# Altium schematic sheet 0221_GPU GDDR6 CHANNELS.SchDoc
size 848 x 558 mm
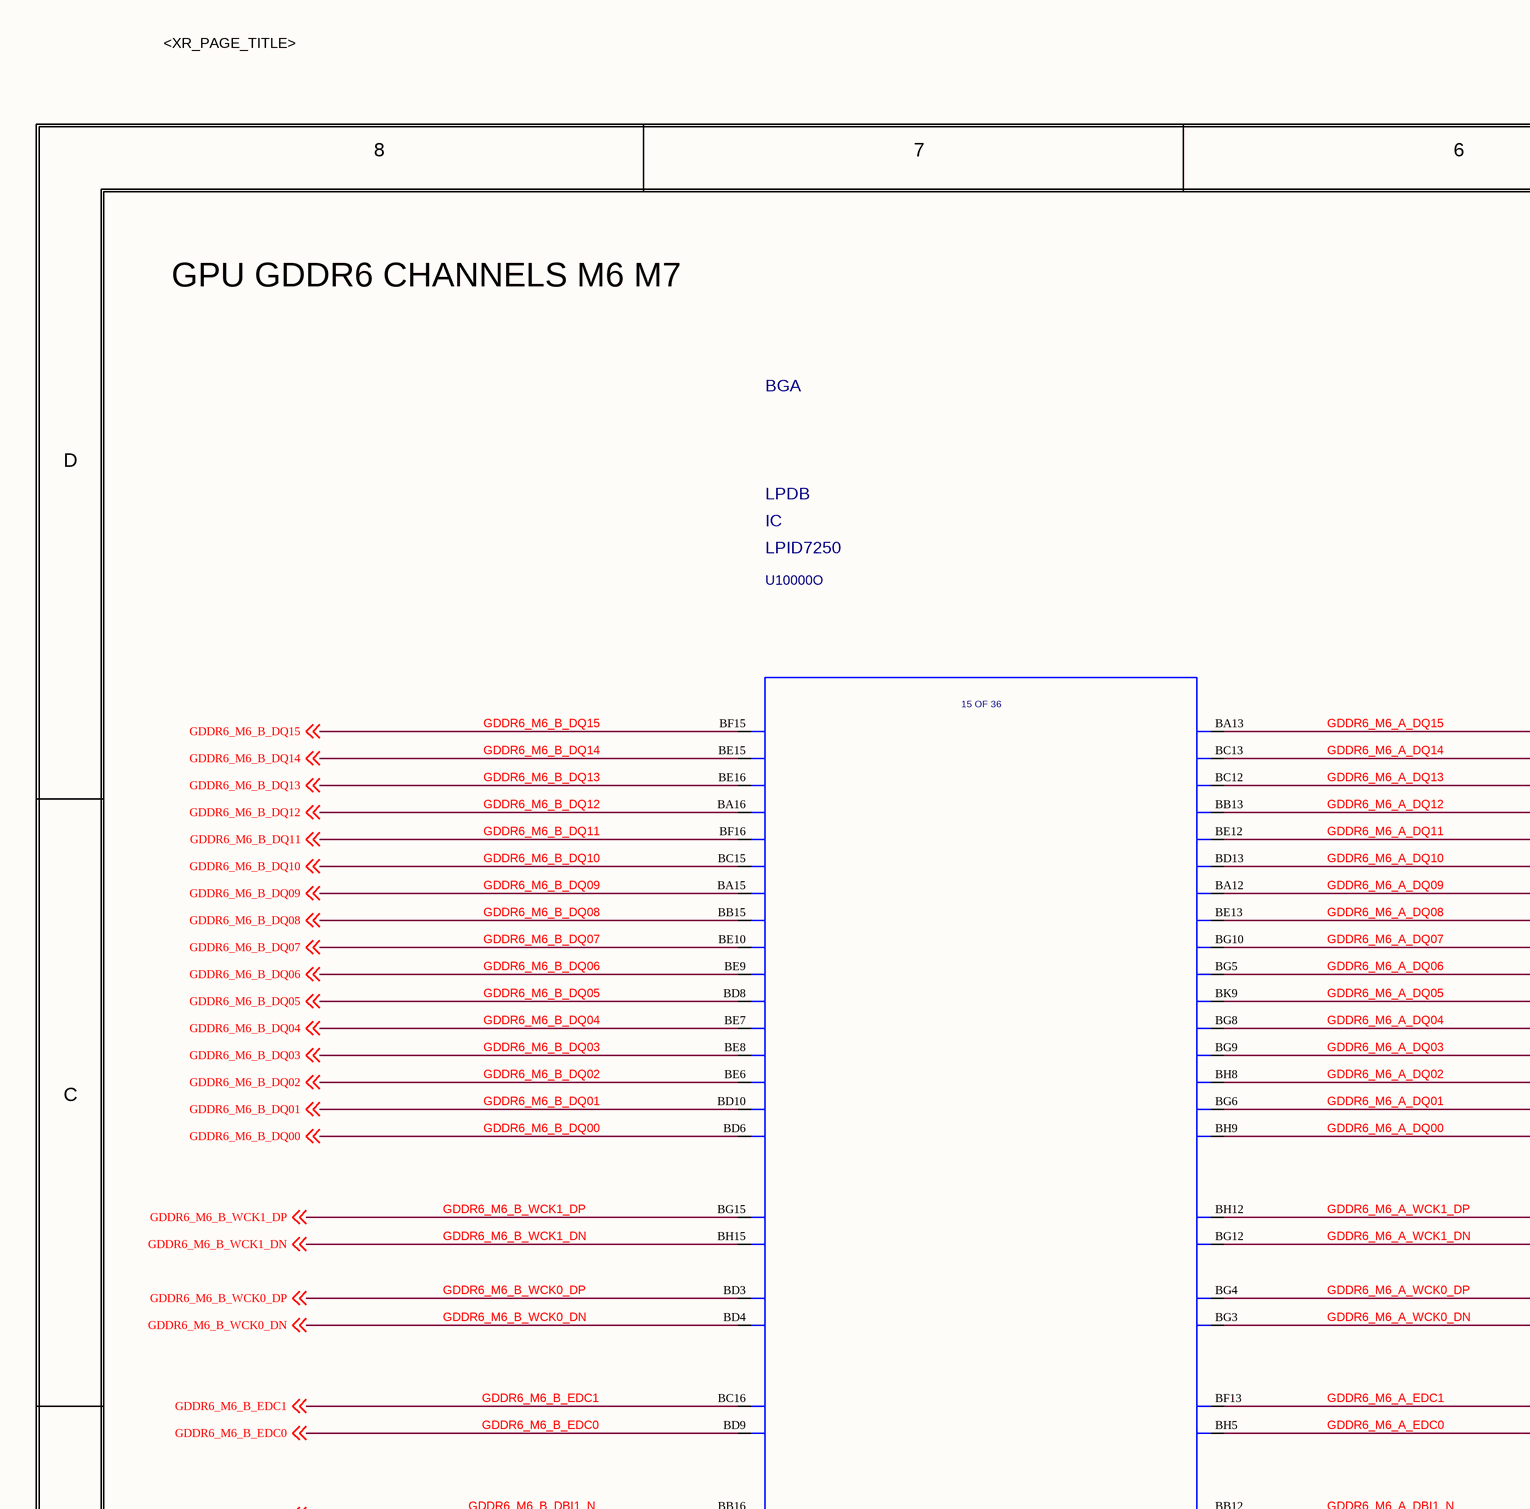
[diagram p0: 0221_GPU GDDR6 CHANNELS.SchDoc, top left]
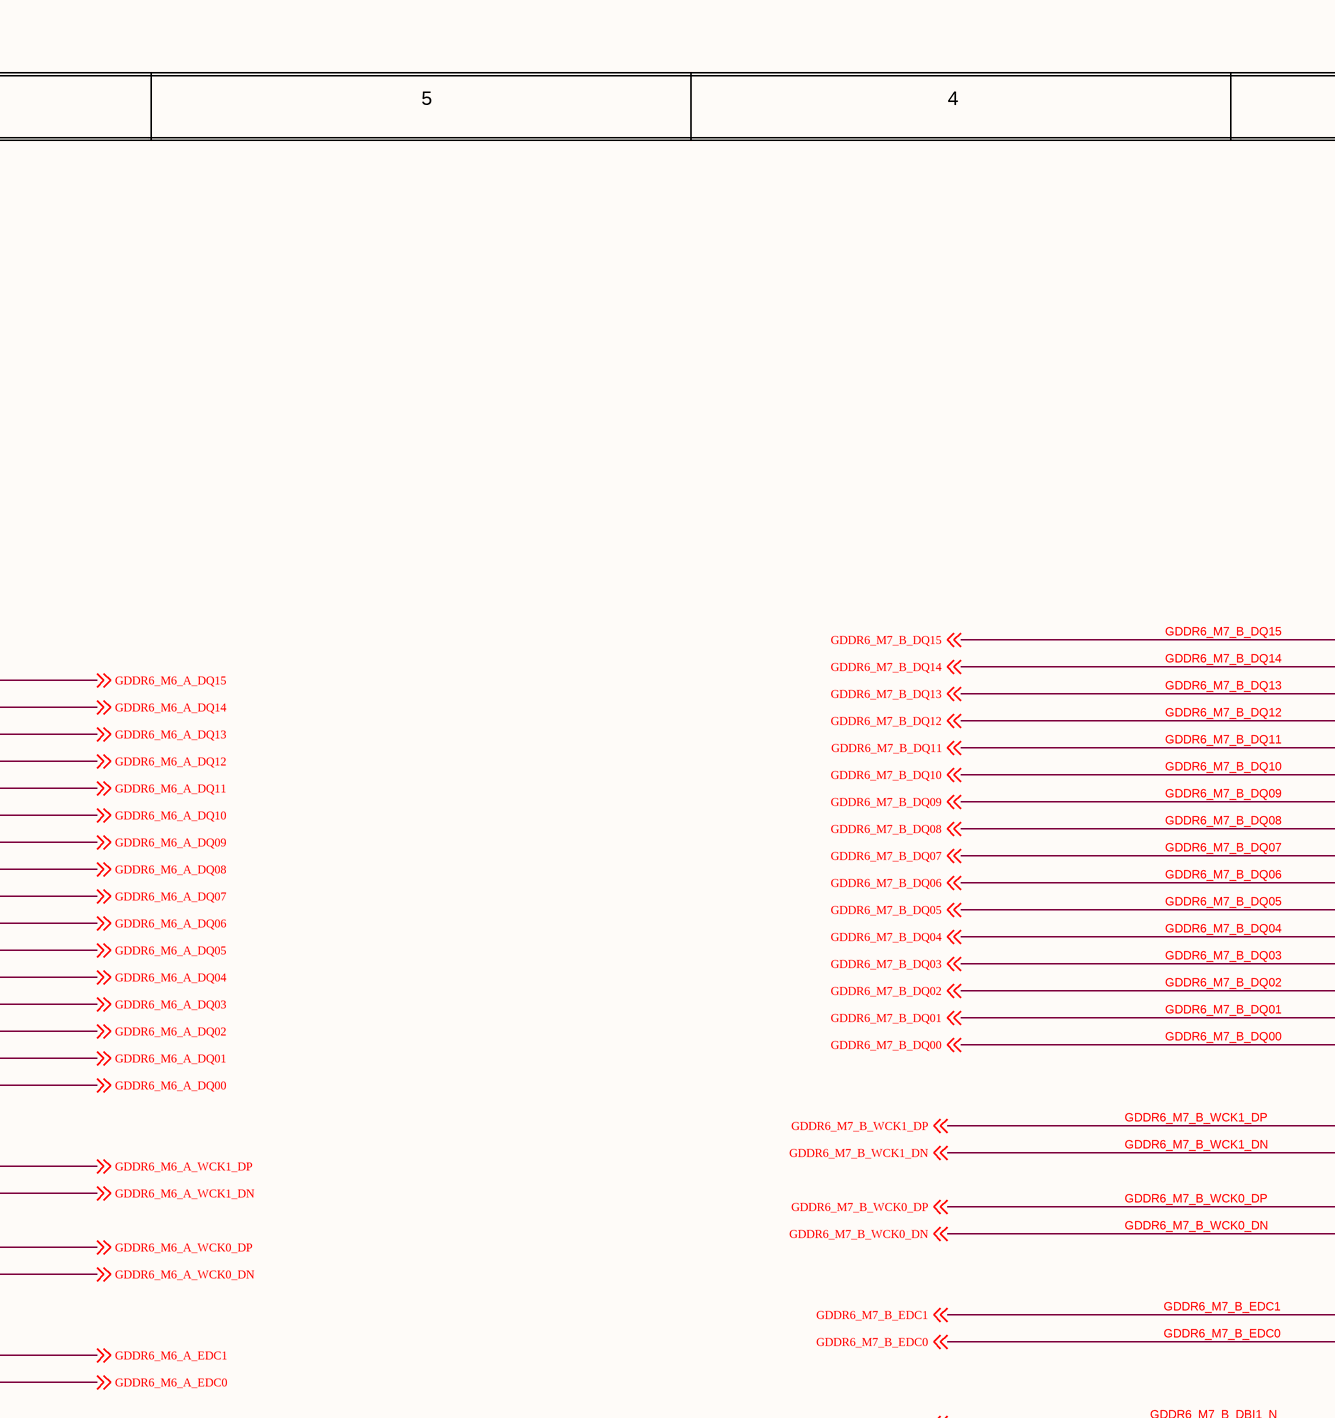
[diagram p1: 0221_GPU GDDR6 CHANNELS.SchDoc, top middle]
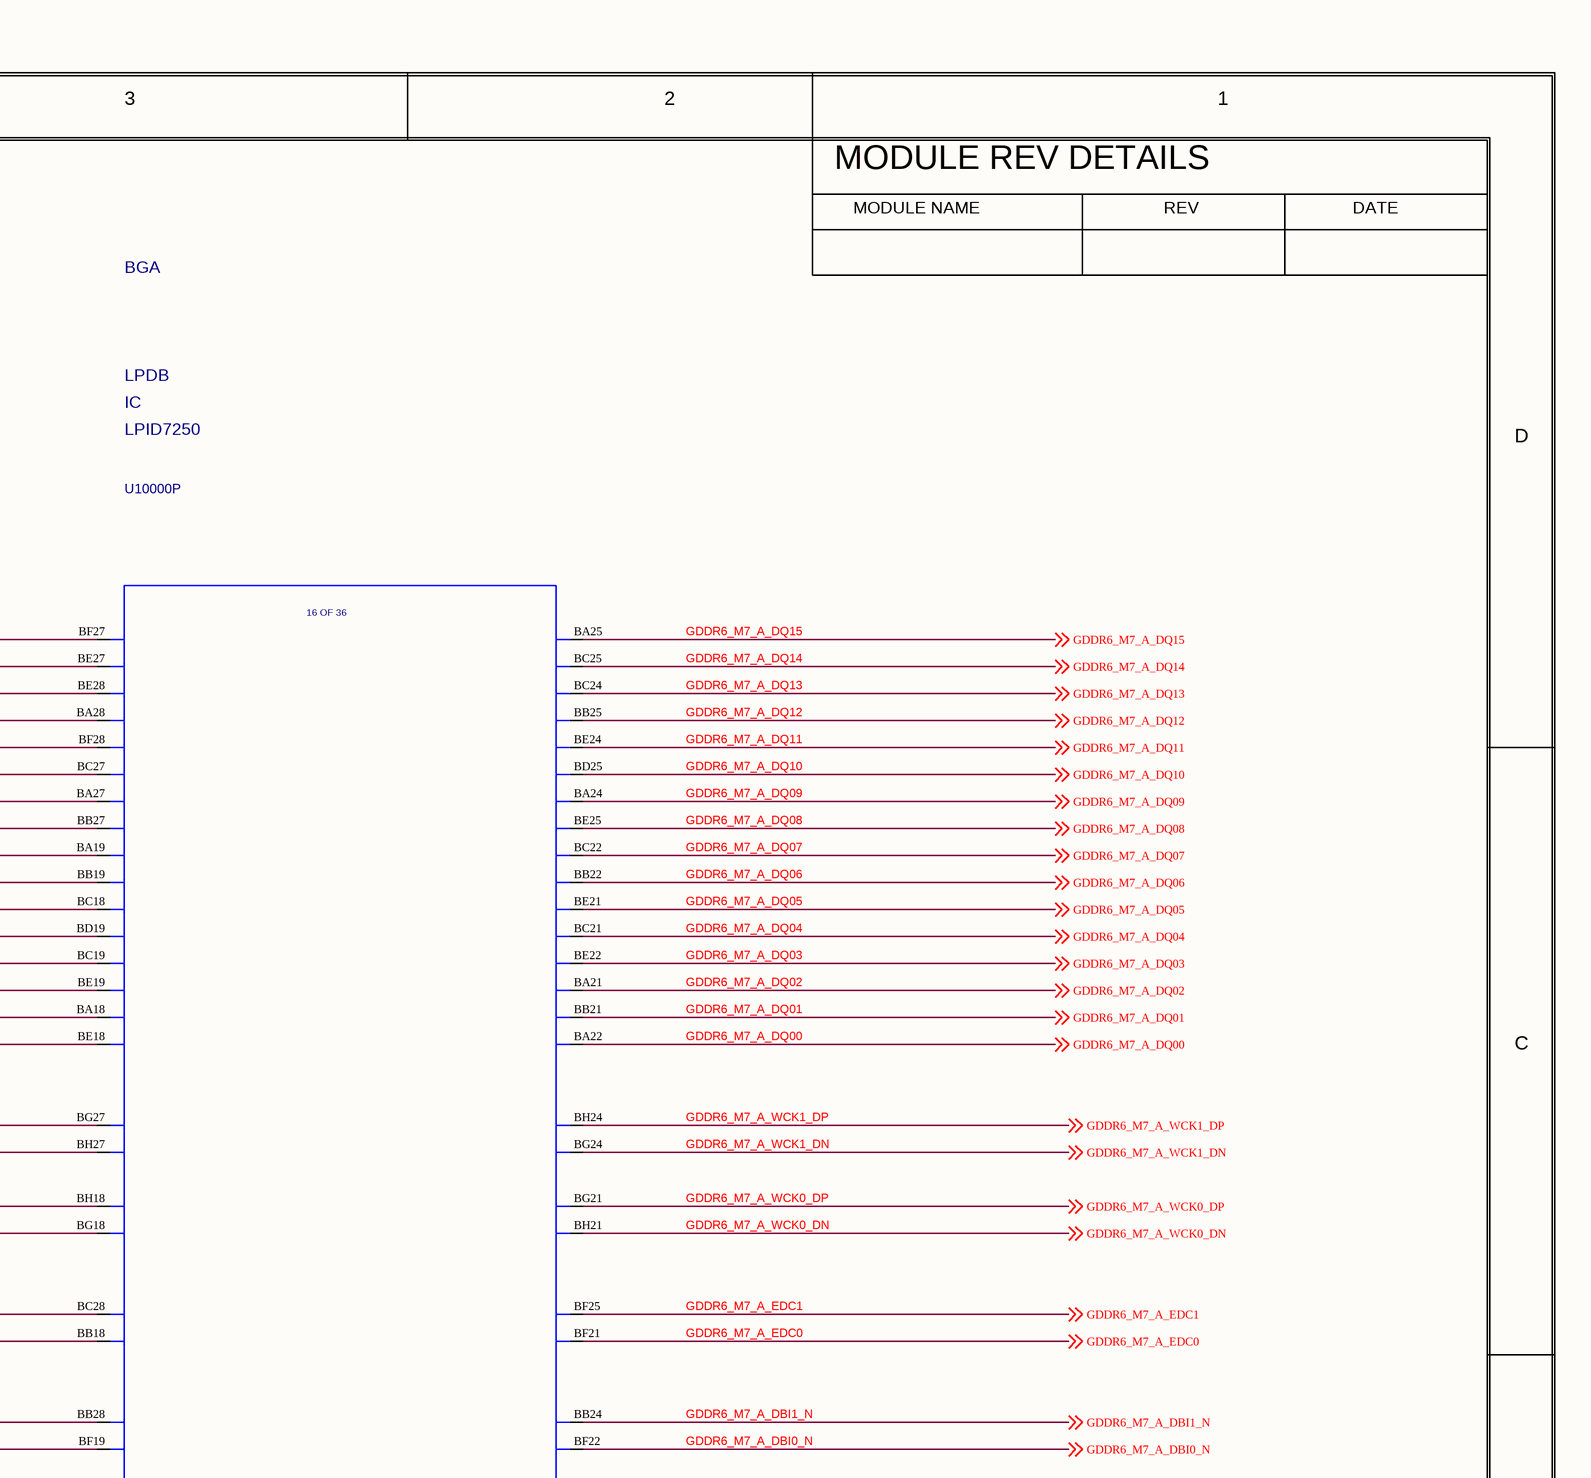
[diagram p2: 0221_GPU GDDR6 CHANNELS.SchDoc, top right]
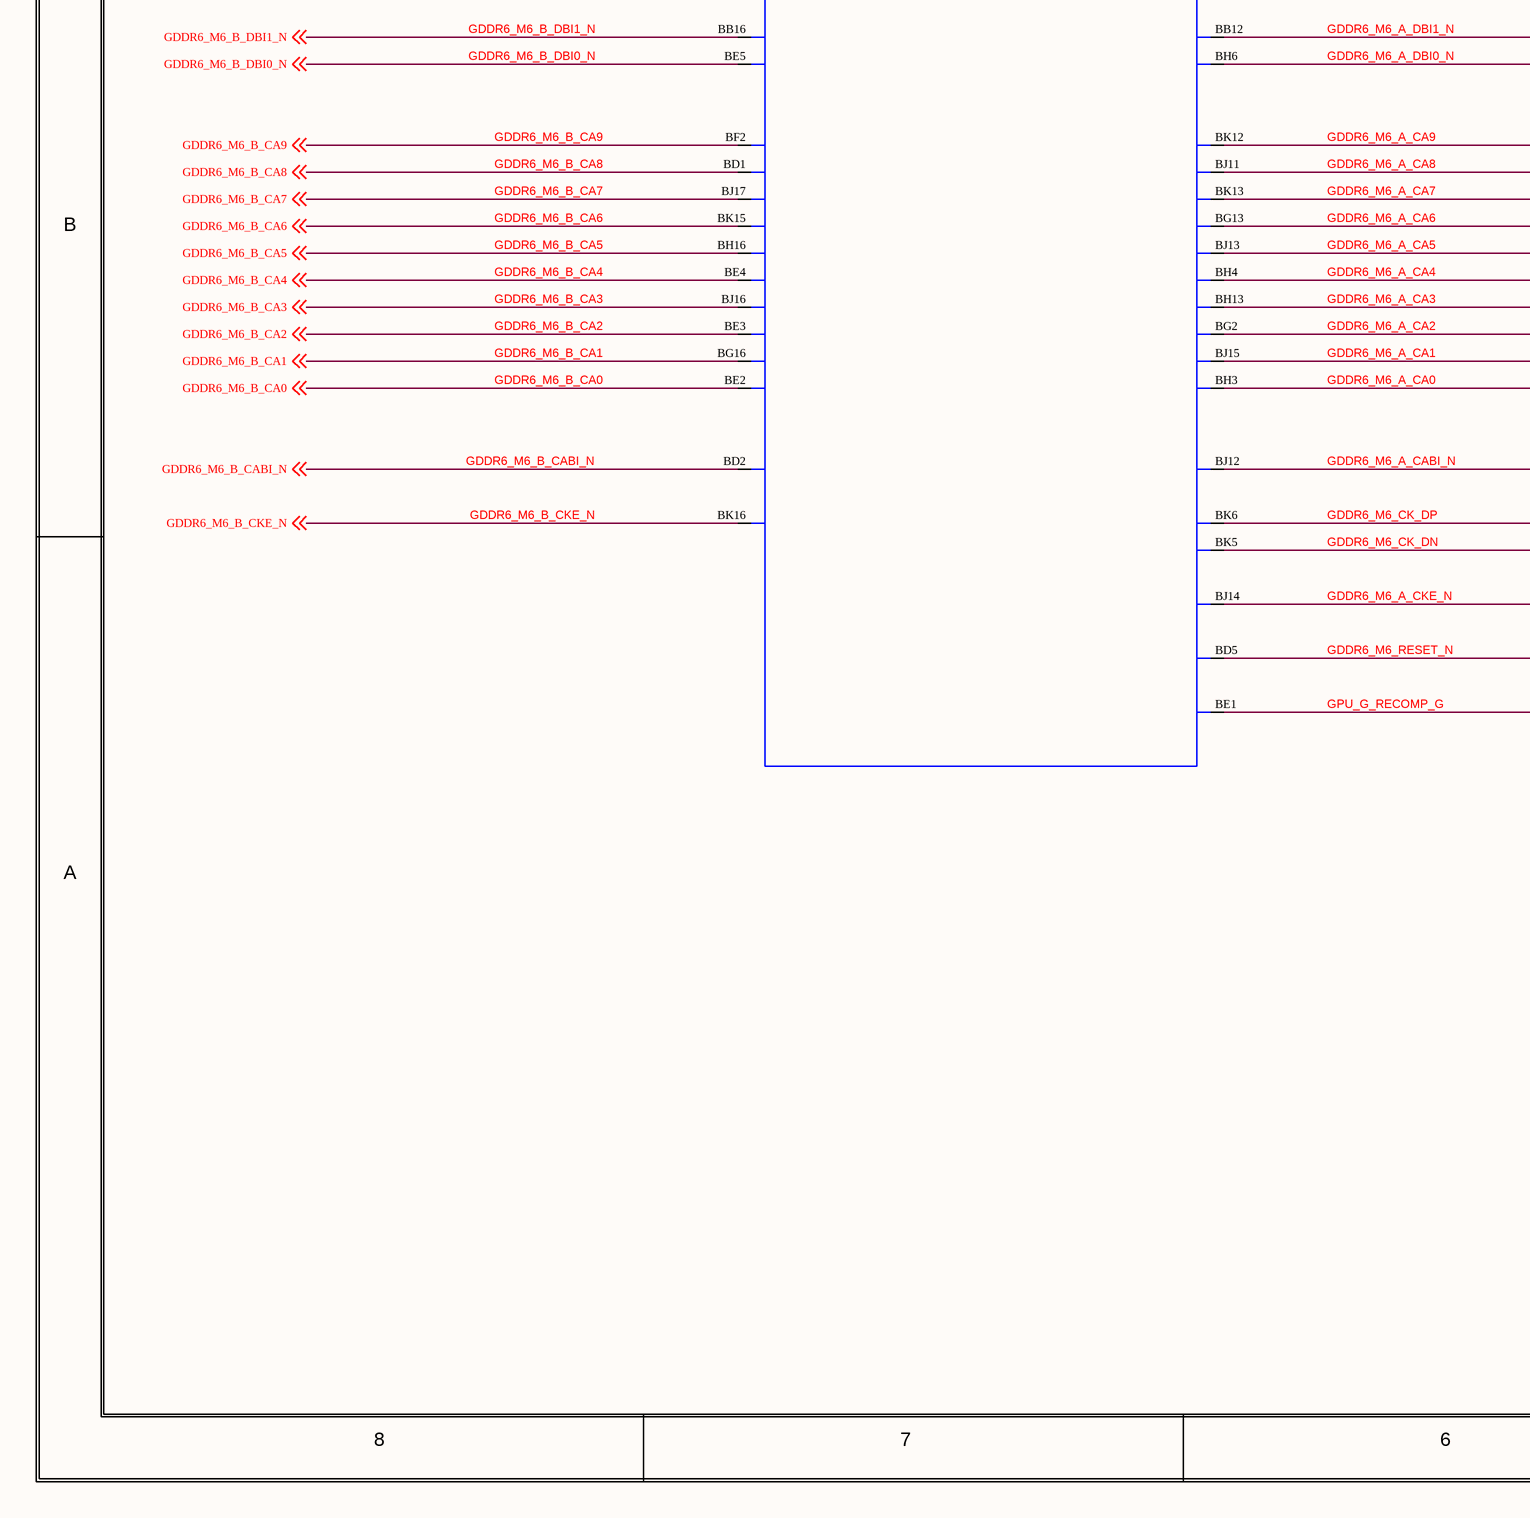
[diagram p3: 0221_GPU GDDR6 CHANNELS.SchDoc, bottom left]
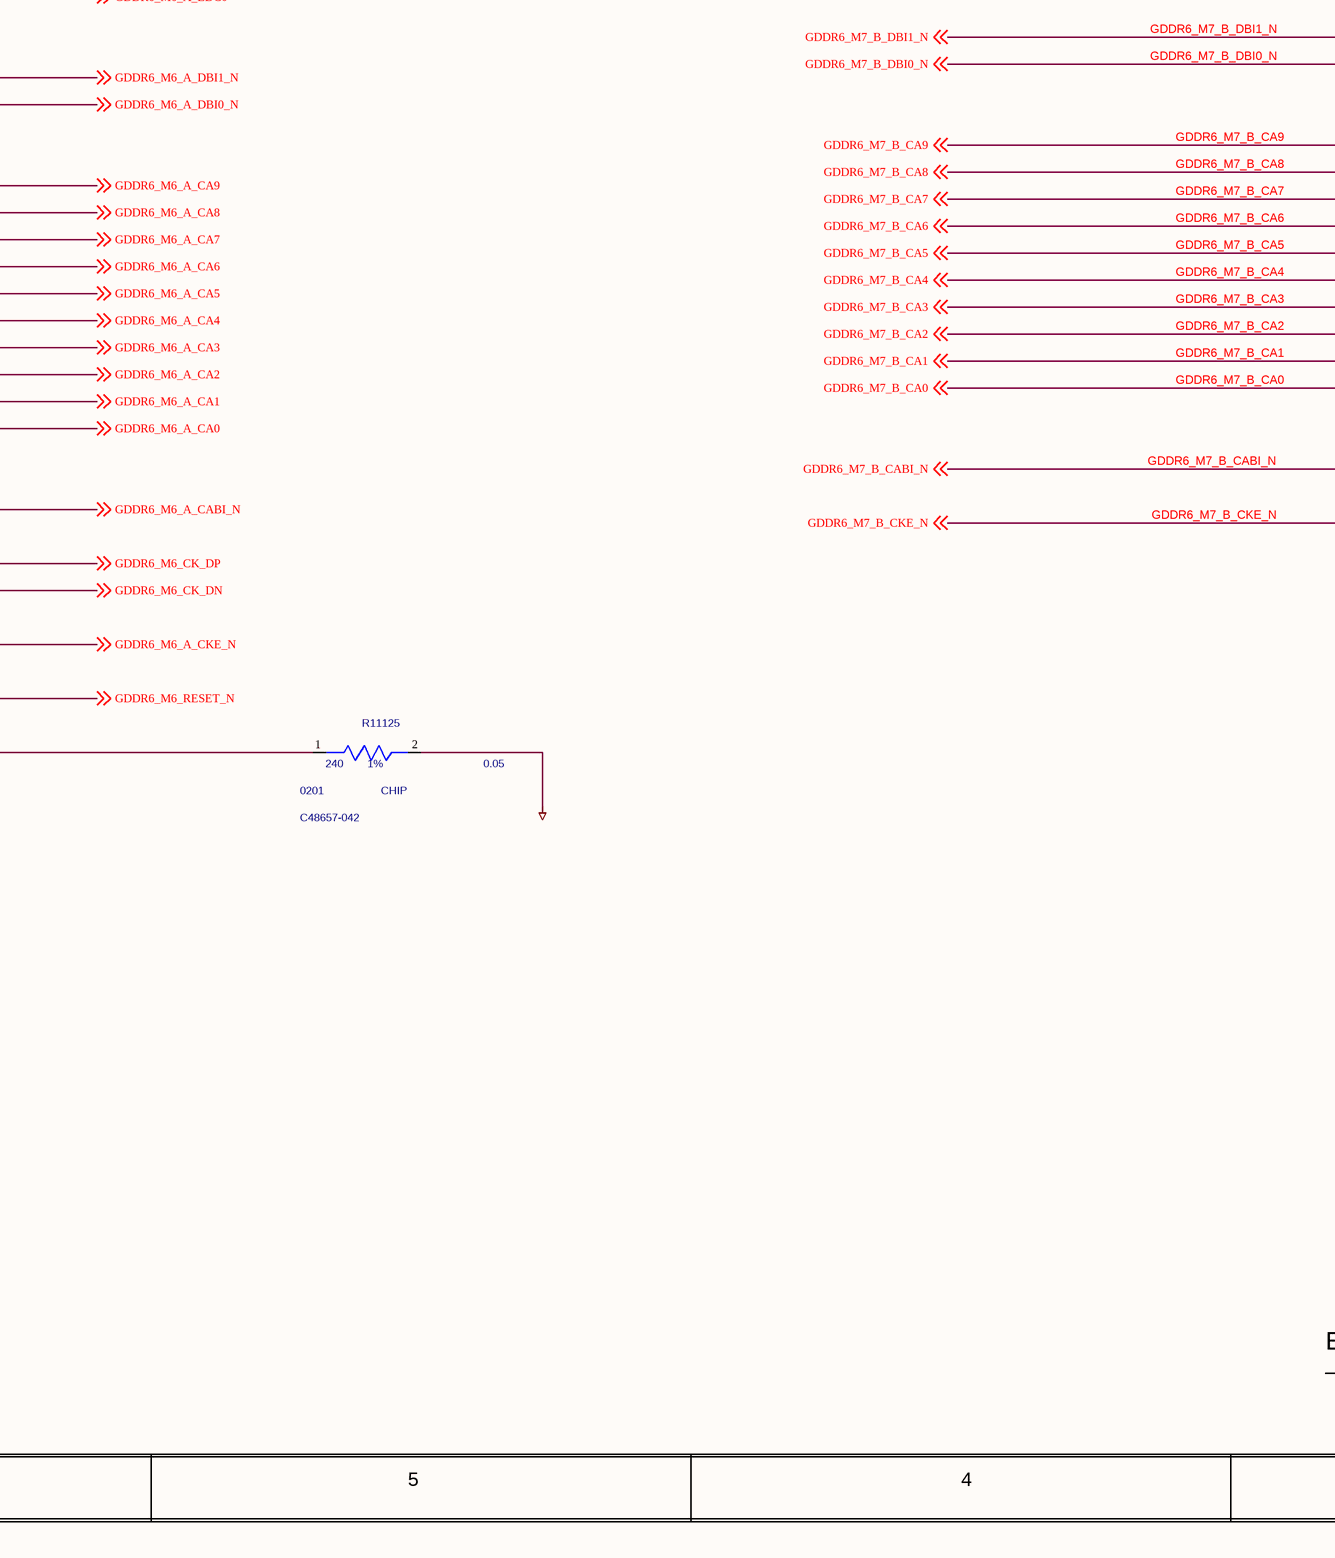
[diagram p4: 0221_GPU GDDR6 CHANNELS.SchDoc, bottom middle]
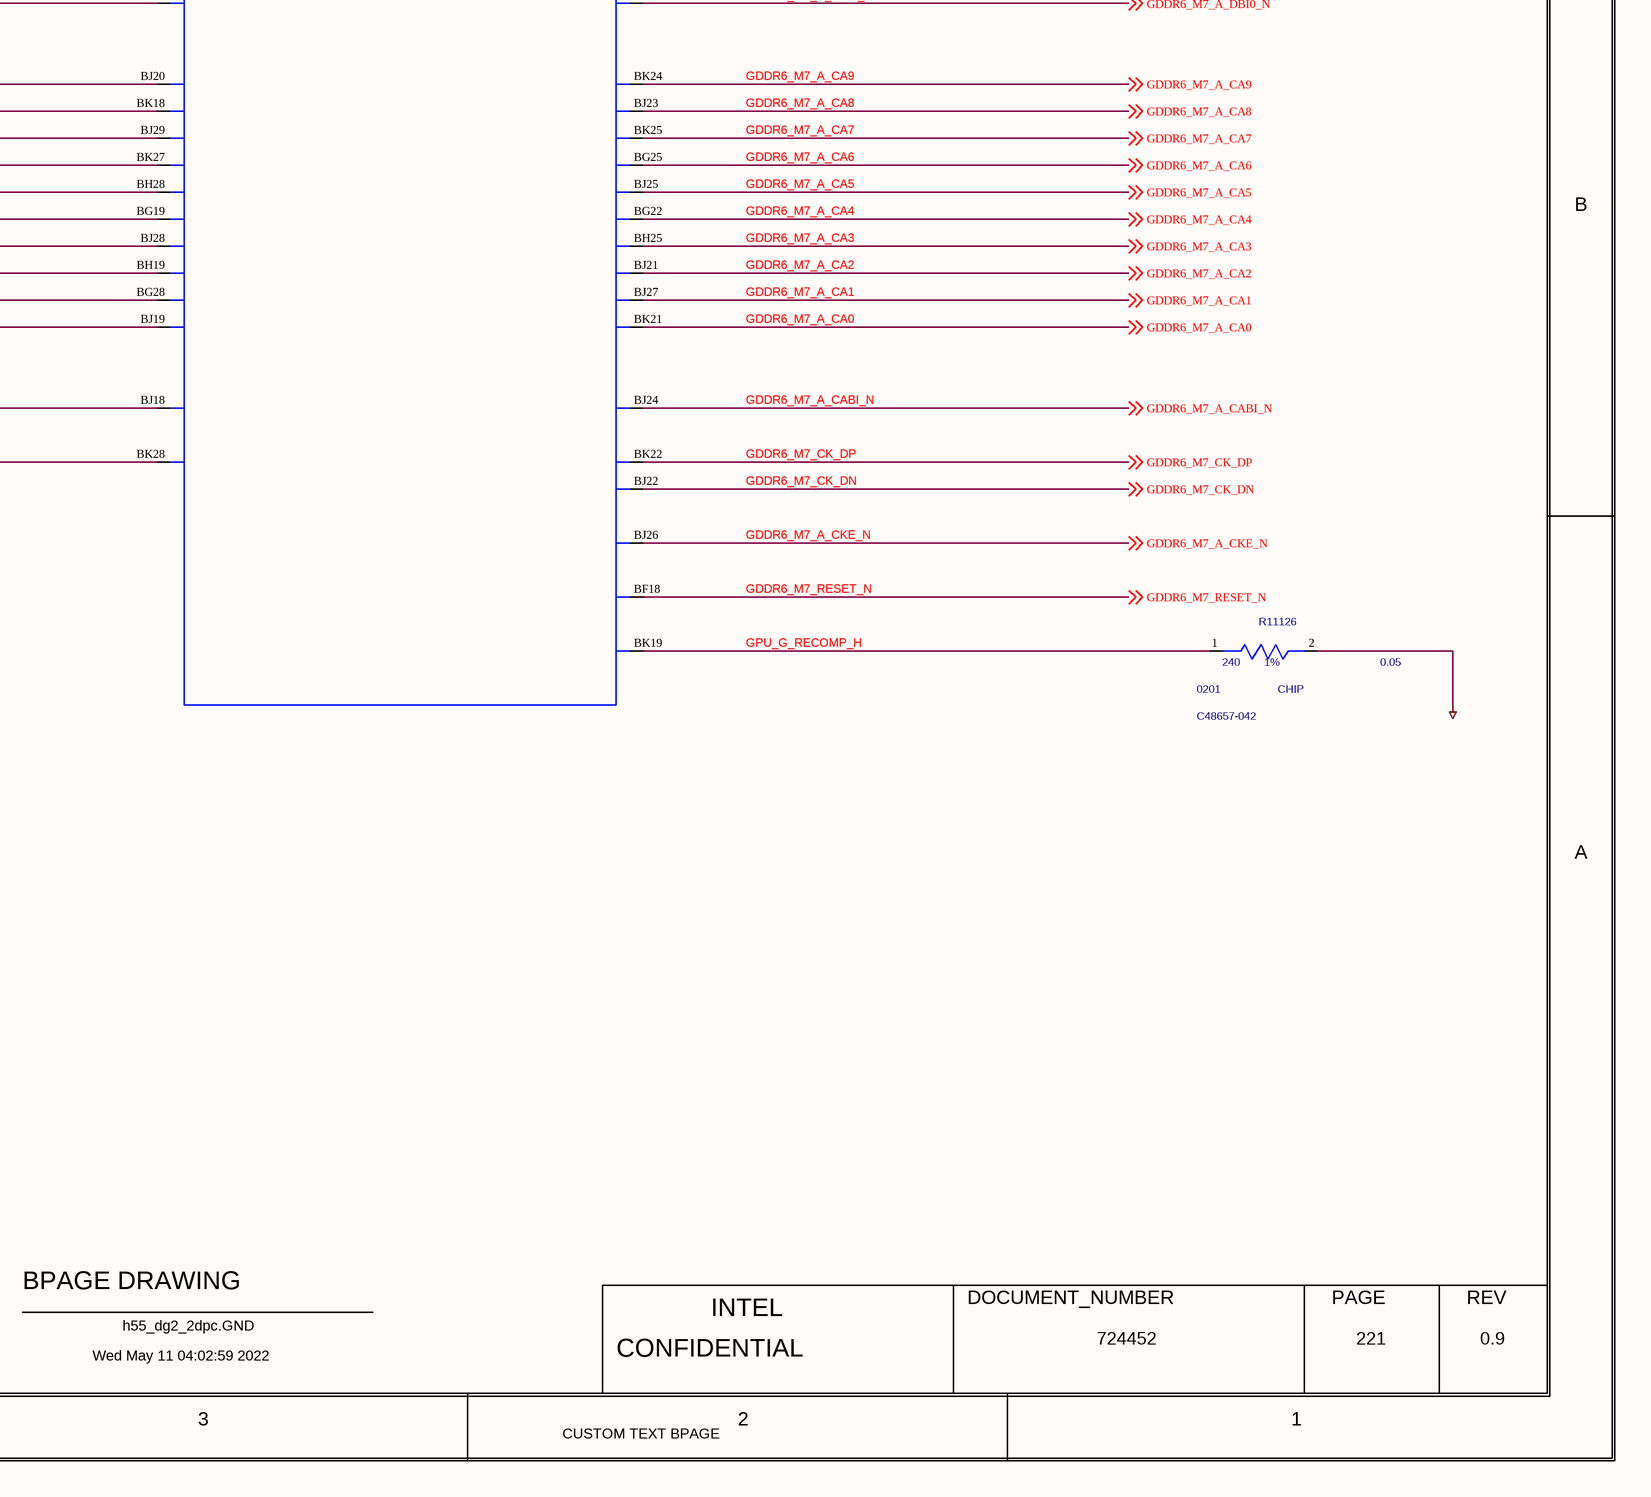
[diagram p5: 0221_GPU GDDR6 CHANNELS.SchDoc, bottom right]

## Parts
R11125  240  MATERIAL: CHIP  PACK_TYPE: 0201  PART_NUMBER: C48657-042  TOLERANCE: 1%  WATTAGE: 0.05  [SMR0201IA]
R11126  240  MATERIAL: CHIP  PACK_TYPE: 0201  PART_NUMBER: C48657-042  TOLERANCE: 1%  WATTAGE: 0.05  [SMR0201IA]
U10000  PART_NUMBER: LPID7250  PACK_TYPE: BGA  MATERIAL: IC  FP_TECH: LPDB  [CLPDB_BGA2660_DG2_SVC_512_LP7250_MA]  (hidden comment: DG2_IP_NB_SKU1_SKU2_SKU3_EXT)  (parts O,P of 36)

## Nets
GND: R11125.2(B) R11126.2(B)
GDDR6_M6_A_CA0: U10000.BH3(GDDR_C6_A_CA0) ; off-sheet GDDR6_M6_A_CA0
GDDR6_M6_A_CA1: U10000.BJ15(GDDR_C6_A_CA1) ; off-sheet GDDR6_M6_A_CA1
GDDR6_M6_A_CA2: U10000.BG2(GDDR_C6_A_CA2) ; off-sheet GDDR6_M6_A_CA2
GDDR6_M6_A_CA3: U10000.BH13(GDDR_C6_A_CA3) ; off-sheet GDDR6_M6_A_CA3
GDDR6_M6_A_CA4: U10000.BH4(GDDR_C6_A_CA4) ; off-sheet GDDR6_M6_A_CA4
GDDR6_M6_A_CA5: U10000.BJ13(GDDR_C6_A_CA5) ; off-sheet GDDR6_M6_A_CA5
GDDR6_M6_A_CA6: U10000.BG13(GDDR_C6_A_CA6) ; off-sheet GDDR6_M6_A_CA6
GDDR6_M6_A_CA7: U10000.BK13(GDDR_C6_A_CA7) ; off-sheet GDDR6_M6_A_CA7
GDDR6_M6_A_CA8: U10000.BJ11(GDDR_C6_A_CA8) ; off-sheet GDDR6_M6_A_CA8
GDDR6_M6_A_CA9: U10000.BK12(GDDR_C6_A_CA9) ; off-sheet GDDR6_M6_A_CA9
GDDR6_M6_A_CABI_N: U10000.BJ12(GDDR_C6_A_CABI_N) ; off-sheet GDDR6_M6_A_CABI_N
GDDR6_M6_A_CKE_N: U10000.BJ14(GDDR_C6_A_CKE_N) ; off-sheet GDDR6_M6_A_CKE_N
GDDR6_M6_A_DBI0_N: U10000.BH6(GDDR_C6_A_DBI0_N) ; off-sheet GDDR6_M6_A_DBI0_N
GDDR6_M6_A_DBI1_N: U10000.BB12(GDDR_C6_A_DBI1_N) ; off-sheet GDDR6_M6_A_DBI1_N
GDDR6_M6_A_DQ00: U10000.BH9(GDDR_C6_A_DQ0) ; off-sheet GDDR6_M6_A_DQ00
GDDR6_M6_A_DQ01: U10000.BG6(GDDR_C6_A_DQ1) ; off-sheet GDDR6_M6_A_DQ01
GDDR6_M6_A_DQ02: U10000.BH8(GDDR_C6_A_DQ2) ; off-sheet GDDR6_M6_A_DQ02
GDDR6_M6_A_DQ03: U10000.BG9(GDDR_C6_A_DQ3) ; off-sheet GDDR6_M6_A_DQ03
GDDR6_M6_A_DQ04: U10000.BG8(GDDR_C6_A_DQ4) ; off-sheet GDDR6_M6_A_DQ04
GDDR6_M6_A_DQ05: U10000.BK9(GDDR_C6_A_DQ5) ; off-sheet GDDR6_M6_A_DQ05
GDDR6_M6_A_DQ06: U10000.BG5(GDDR_C6_A_DQ6) ; off-sheet GDDR6_M6_A_DQ06
GDDR6_M6_A_DQ07: U10000.BG10(GDDR_C6_A_DQ7) ; off-sheet GDDR6_M6_A_DQ07
GDDR6_M6_A_DQ08: U10000.BE13(GDDR_C6_A_DQ8) ; off-sheet GDDR6_M6_A_DQ08
GDDR6_M6_A_DQ09: U10000.BA12(GDDR_C6_A_DQ9) ; off-sheet GDDR6_M6_A_DQ09
GDDR6_M6_A_DQ10: U10000.BD13(GDDR_C6_A_DQ10) ; off-sheet GDDR6_M6_A_DQ10
GDDR6_M6_A_DQ11: U10000.BE12(GDDR_C6_A_DQ11) ; off-sheet GDDR6_M6_A_DQ11
GDDR6_M6_A_DQ12: U10000.BB13(GDDR_C6_A_DQ12) ; off-sheet GDDR6_M6_A_DQ12
GDDR6_M6_A_DQ13: U10000.BC12(GDDR_C6_A_DQ13) ; off-sheet GDDR6_M6_A_DQ13
GDDR6_M6_A_DQ14: U10000.BC13(GDDR_C6_A_DQ14) ; off-sheet GDDR6_M6_A_DQ14
GDDR6_M6_A_DQ15: U10000.BA13(GDDR_C6_A_DQ15) ; off-sheet GDDR6_M6_A_DQ15
GDDR6_M6_A_EDC0: U10000.BH5(GDDR_C6_A_EDC0) ; off-sheet GDDR6_M6_A_EDC0
GDDR6_M6_A_EDC1: U10000.BF13(GDDR_C6_A_EDC1) ; off-sheet GDDR6_M6_A_EDC1
GDDR6_M6_A_WCK0_DN: U10000.BG3(GDDR_C6_A_WCK0_DN) ; off-sheet GDDR6_M6_A_WCK0_DN
GDDR6_M6_A_WCK0_DP: U10000.BG4(GDDR_C6_A_WCK0_DP) ; off-sheet GDDR6_M6_A_WCK0_DP
GDDR6_M6_A_WCK1_DN: U10000.BG12(GDDR_C6_A_WCK1_DN) ; off-sheet GDDR6_M6_A_WCK1_DN
GDDR6_M6_A_WCK1_DP: U10000.BH12(GDDR_C6_A_WCK1_DP) ; off-sheet GDDR6_M6_A_WCK1_DP
GDDR6_M6_B_CA0: U10000.BE2(GDDR_C6_B_CA0) ; off-sheet GDDR6_M6_B_CA0
GDDR6_M6_B_CA1: U10000.BG16(GDDR_C6_B_CA1) ; off-sheet GDDR6_M6_B_CA1
GDDR6_M6_B_CA2: U10000.BE3(GDDR_C6_B_CA2) ; off-sheet GDDR6_M6_B_CA2
GDDR6_M6_B_CA3: U10000.BJ16(GDDR_C6_B_CA3) ; off-sheet GDDR6_M6_B_CA3
GDDR6_M6_B_CA4: U10000.BE4(GDDR_C6_B_CA4) ; off-sheet GDDR6_M6_B_CA4
GDDR6_M6_B_CA5: U10000.BH16(GDDR_C6_B_CA5) ; off-sheet GDDR6_M6_B_CA5
GDDR6_M6_B_CA6: U10000.BK15(GDDR_C6_B_CA6) ; off-sheet GDDR6_M6_B_CA6
GDDR6_M6_B_CA7: U10000.BJ17(GDDR_C6_B_CA7) ; off-sheet GDDR6_M6_B_CA7
GDDR6_M6_B_CA8: U10000.BD1(GDDR_C6_B_CA8) ; off-sheet GDDR6_M6_B_CA8
GDDR6_M6_B_CA9: U10000.BF2(GDDR_C6_B_CA9) ; off-sheet GDDR6_M6_B_CA9
GDDR6_M6_B_CABI_N: U10000.BD2(GDDR_C6_B_CABI_N) ; off-sheet GDDR6_M6_B_CABI_N
GDDR6_M6_B_CKE_N: U10000.BK16(GDDR_C6_B_CKE_N) ; off-sheet GDDR6_M6_B_CKE_N
GDDR6_M6_B_DBI0_N: U10000.BE5(GDDR_C6_B_DBI0_N) ; off-sheet GDDR6_M6_B_DBI0_N
GDDR6_M6_B_DBI1_N: U10000.BB16(GDDR_C6_B_DBI1_N) ; off-sheet GDDR6_M6_B_DBI1_N
GDDR6_M6_B_DQ00: U10000.BD6(GDDR_C6_B_DQ0) ; off-sheet GDDR6_M6_B_DQ00
GDDR6_M6_B_DQ01: U10000.BD10(GDDR_C6_B_DQ1) ; off-sheet GDDR6_M6_B_DQ01
GDDR6_M6_B_DQ02: U10000.BE6(GDDR_C6_B_DQ2) ; off-sheet GDDR6_M6_B_DQ02
GDDR6_M6_B_DQ03: U10000.BE8(GDDR_C6_B_DQ3) ; off-sheet GDDR6_M6_B_DQ03
GDDR6_M6_B_DQ04: U10000.BE7(GDDR_C6_B_DQ4) ; off-sheet GDDR6_M6_B_DQ04
GDDR6_M6_B_DQ05: U10000.BD8(GDDR_C6_B_DQ5) ; off-sheet GDDR6_M6_B_DQ05
GDDR6_M6_B_DQ06: U10000.BE9(GDDR_C6_B_DQ6) ; off-sheet GDDR6_M6_B_DQ06
GDDR6_M6_B_DQ07: U10000.BE10(GDDR_C6_B_DQ7) ; off-sheet GDDR6_M6_B_DQ07
GDDR6_M6_B_DQ08: U10000.BB15(GDDR_C6_B_DQ8) ; off-sheet GDDR6_M6_B_DQ08
GDDR6_M6_B_DQ09: U10000.BA15(GDDR_C6_B_DQ9) ; off-sheet GDDR6_M6_B_DQ09
GDDR6_M6_B_DQ10: U10000.BC15(GDDR_C6_B_DQ10) ; off-sheet GDDR6_M6_B_DQ10
GDDR6_M6_B_DQ11: U10000.BF16(GDDR_C6_B_DQ11) ; off-sheet GDDR6_M6_B_DQ11
GDDR6_M6_B_DQ12: U10000.BA16(GDDR_C6_B_DQ12) ; off-sheet GDDR6_M6_B_DQ12
GDDR6_M6_B_DQ13: U10000.BE16(GDDR_C6_B_DQ13) ; off-sheet GDDR6_M6_B_DQ13
GDDR6_M6_B_DQ14: U10000.BE15(GDDR_C6_B_DQ14) ; off-sheet GDDR6_M6_B_DQ14
GDDR6_M6_B_DQ15: U10000.BF15(GDDR_C6_B_DQ15) ; off-sheet GDDR6_M6_B_DQ15
GDDR6_M6_B_EDC0: U10000.BD9(GDDR_C6_B_EDC0) ; off-sheet GDDR6_M6_B_EDC0
GDDR6_M6_B_EDC1: U10000.BC16(GDDR_C6_B_EDC1) ; off-sheet GDDR6_M6_B_EDC1
GDDR6_M6_B_WCK0_DN: U10000.BD4(GDDR_C6_B_WCK0_DN) ; off-sheet GDDR6_M6_B_WCK0_DN
GDDR6_M6_B_WCK0_DP: U10000.BD3(GDDR_C6_B_WCK0_DP) ; off-sheet GDDR6_M6_B_WCK0_DP
GDDR6_M6_B_WCK1_DN: U10000.BH15(GDDR_C6_B_WCK1_DN) ; off-sheet GDDR6_M6_B_WCK1_DN
GDDR6_M6_B_WCK1_DP: U10000.BG15(GDDR_C6_B_WCK1_DP) ; off-sheet GDDR6_M6_B_WCK1_DP
GDDR6_M6_CK_DN: U10000.BK5(GDDR_C6_CK_DN) ; off-sheet GDDR6_M6_CK_DN
GDDR6_M6_CK_DP: U10000.BK6(GDDR_C6_CK_DP) ; off-sheet GDDR6_M6_CK_DP
GDDR6_M6_RESET_N: U10000.BD5(GDDR_C6_RESET_N) ; off-sheet GDDR6_M6_RESET_N
GDDR6_M7_A_CA0: U10000.BK21(GDDR_C7_A_CA0) ; off-sheet GDDR6_M7_A_CA0
GDDR6_M7_A_CA1: U10000.BJ27(GDDR_C7_A_CA1) ; off-sheet GDDR6_M7_A_CA1
GDDR6_M7_A_CA2: U10000.BJ21(GDDR_C7_A_CA2) ; off-sheet GDDR6_M7_A_CA2
GDDR6_M7_A_CA3: U10000.BH25(GDDR_C7_A_CA3) ; off-sheet GDDR6_M7_A_CA3
GDDR6_M7_A_CA4: U10000.BG22(GDDR_C7_A_CA4) ; off-sheet GDDR6_M7_A_CA4
GDDR6_M7_A_CA5: U10000.BJ25(GDDR_C7_A_CA5) ; off-sheet GDDR6_M7_A_CA5
GDDR6_M7_A_CA6: U10000.BG25(GDDR_C7_A_CA6) ; off-sheet GDDR6_M7_A_CA6
GDDR6_M7_A_CA7: U10000.BK25(GDDR_C7_A_CA7) ; off-sheet GDDR6_M7_A_CA7
GDDR6_M7_A_CA8: U10000.BJ23(GDDR_C7_A_CA8) ; off-sheet GDDR6_M7_A_CA8
GDDR6_M7_A_CA9: U10000.BK24(GDDR_C7_A_CA9) ; off-sheet GDDR6_M7_A_CA9
GDDR6_M7_A_CABI_N: U10000.BJ24(GDDR_C7_A_CABI_N) ; off-sheet GDDR6_M7_A_CABI_N
GDDR6_M7_A_CKE_N: U10000.BJ26(GDDR_C7_A_CKE_N) ; off-sheet GDDR6_M7_A_CKE_N
GDDR6_M7_A_DBI0_N: U10000.BF22(GDDR_C7_A_DBI0_N) ; off-sheet GDDR6_M7_A_DBI0_N
GDDR6_M7_A_DBI1_N: U10000.BB24(GDDR_C7_A_DBI1_N) ; off-sheet GDDR6_M7_A_DBI1_N
GDDR6_M7_A_DQ00: U10000.BA22(GDDR_C7_A_DQ0) ; off-sheet GDDR6_M7_A_DQ00
GDDR6_M7_A_DQ01: U10000.BB21(GDDR_C7_A_DQ1) ; off-sheet GDDR6_M7_A_DQ01
GDDR6_M7_A_DQ02: U10000.BA21(GDDR_C7_A_DQ2) ; off-sheet GDDR6_M7_A_DQ02
GDDR6_M7_A_DQ03: U10000.BE22(GDDR_C7_A_DQ3) ; off-sheet GDDR6_M7_A_DQ03
GDDR6_M7_A_DQ04: U10000.BC21(GDDR_C7_A_DQ4) ; off-sheet GDDR6_M7_A_DQ04
GDDR6_M7_A_DQ05: U10000.BE21(GDDR_C7_A_DQ5) ; off-sheet GDDR6_M7_A_DQ05
GDDR6_M7_A_DQ06: U10000.BB22(GDDR_C7_A_DQ6) ; off-sheet GDDR6_M7_A_DQ06
GDDR6_M7_A_DQ07: U10000.BC22(GDDR_C7_A_DQ7) ; off-sheet GDDR6_M7_A_DQ07
GDDR6_M7_A_DQ08: U10000.BE25(GDDR_C7_A_DQ8) ; off-sheet GDDR6_M7_A_DQ08
GDDR6_M7_A_DQ09: U10000.BA24(GDDR_C7_A_DQ9) ; off-sheet GDDR6_M7_A_DQ09
GDDR6_M7_A_DQ10: U10000.BD25(GDDR_C7_A_DQ10) ; off-sheet GDDR6_M7_A_DQ10
GDDR6_M7_A_DQ11: U10000.BE24(GDDR_C7_A_DQ11) ; off-sheet GDDR6_M7_A_DQ11
GDDR6_M7_A_DQ12: U10000.BB25(GDDR_C7_A_DQ12) ; off-sheet GDDR6_M7_A_DQ12
GDDR6_M7_A_DQ13: U10000.BC24(GDDR_C7_A_DQ13) ; off-sheet GDDR6_M7_A_DQ13
GDDR6_M7_A_DQ14: U10000.BC25(GDDR_C7_A_DQ14) ; off-sheet GDDR6_M7_A_DQ14
GDDR6_M7_A_DQ15: U10000.BA25(GDDR_C7_A_DQ15) ; off-sheet GDDR6_M7_A_DQ15
GDDR6_M7_A_EDC0: U10000.BF21(GDDR_C7_A_EDC0) ; off-sheet GDDR6_M7_A_EDC0
GDDR6_M7_A_EDC1: U10000.BF25(GDDR_C7_A_EDC1) ; off-sheet GDDR6_M7_A_EDC1
GDDR6_M7_A_WCK0_DN: U10000.BH21(GDDR_C7_A_WCK0_DN) ; off-sheet GDDR6_M7_A_WCK0_DN
GDDR6_M7_A_WCK0_DP: U10000.BG21(GDDR_C7_A_WCK0_DP) ; off-sheet GDDR6_M7_A_WCK0_DP
GDDR6_M7_A_WCK1_DN: U10000.BG24(GDDR_C7_A_WCK1_DN) ; off-sheet GDDR6_M7_A_WCK1_DN
GDDR6_M7_A_WCK1_DP: U10000.BH24(GDDR_C7_A_WCK1_DP) ; off-sheet GDDR6_M7_A_WCK1_DP
GDDR6_M7_B_CA0: U10000.BJ19(GDDR_C7_B_CA0) ; off-sheet GDDR6_M7_B_CA0
GDDR6_M7_B_CA1: U10000.BG28(GDDR_C7_B_CA1) ; off-sheet GDDR6_M7_B_CA1
GDDR6_M7_B_CA2: U10000.BH19(GDDR_C7_B_CA2) ; off-sheet GDDR6_M7_B_CA2
GDDR6_M7_B_CA3: U10000.BJ28(GDDR_C7_B_CA3) ; off-sheet GDDR6_M7_B_CA3
GDDR6_M7_B_CA4: U10000.BG19(GDDR_C7_B_CA4) ; off-sheet GDDR6_M7_B_CA4
GDDR6_M7_B_CA5: U10000.BH28(GDDR_C7_B_CA5) ; off-sheet GDDR6_M7_B_CA5
GDDR6_M7_B_CA6: U10000.BK27(GDDR_C7_B_CA6) ; off-sheet GDDR6_M7_B_CA6
GDDR6_M7_B_CA7: U10000.BJ29(GDDR_C7_B_CA7) ; off-sheet GDDR6_M7_B_CA7
GDDR6_M7_B_CA8: U10000.BK18(GDDR_C7_B_CA8) ; off-sheet GDDR6_M7_B_CA8
GDDR6_M7_B_CA9: U10000.BJ20(GDDR_C7_B_CA9) ; off-sheet GDDR6_M7_B_CA9
GDDR6_M7_B_CABI_N: U10000.BJ18(GDDR_C7_B_CABI_N) ; off-sheet GDDR6_M7_B_CABI_N
GDDR6_M7_B_CKE_N: U10000.BK28(GDDR_C7_B_CKE_N) ; off-sheet GDDR6_M7_B_CKE_N
GDDR6_M7_B_DBI0_N: U10000.BF19(GDDR_C7_B_DBI0_N) ; off-sheet GDDR6_M7_B_DBI0_N
GDDR6_M7_B_DBI1_N: U10000.BB28(GDDR_C7_B_DBI1_N) ; off-sheet GDDR6_M7_B_DBI1_N
GDDR6_M7_B_DQ00: U10000.BE18(GDDR_C7_B_DQ0) ; off-sheet GDDR6_M7_B_DQ00
GDDR6_M7_B_DQ01: U10000.BA18(GDDR_C7_B_DQ1) ; off-sheet GDDR6_M7_B_DQ01
GDDR6_M7_B_DQ02: U10000.BE19(GDDR_C7_B_DQ2) ; off-sheet GDDR6_M7_B_DQ02
GDDR6_M7_B_DQ03: U10000.BC19(GDDR_C7_B_DQ3) ; off-sheet GDDR6_M7_B_DQ03
GDDR6_M7_B_DQ04: U10000.BD19(GDDR_C7_B_DQ4) ; off-sheet GDDR6_M7_B_DQ04
GDDR6_M7_B_DQ05: U10000.BC18(GDDR_C7_B_DQ5) ; off-sheet GDDR6_M7_B_DQ05
GDDR6_M7_B_DQ06: U10000.BB19(GDDR_C7_B_DQ6) ; off-sheet GDDR6_M7_B_DQ06
GDDR6_M7_B_DQ07: U10000.BA19(GDDR_C7_B_DQ7) ; off-sheet GDDR6_M7_B_DQ07
GDDR6_M7_B_DQ08: U10000.BB27(GDDR_C7_B_DQ8) ; off-sheet GDDR6_M7_B_DQ08
GDDR6_M7_B_DQ09: U10000.BA27(GDDR_C7_B_DQ9) ; off-sheet GDDR6_M7_B_DQ09
GDDR6_M7_B_DQ10: U10000.BC27(GDDR_C7_B_DQ10) ; off-sheet GDDR6_M7_B_DQ10
GDDR6_M7_B_DQ11: U10000.BF28(GDDR_C7_B_DQ11) ; off-sheet GDDR6_M7_B_DQ11
GDDR6_M7_B_DQ12: U10000.BA28(GDDR_C7_B_DQ12) ; off-sheet GDDR6_M7_B_DQ12
GDDR6_M7_B_DQ13: U10000.BE28(GDDR_C7_B_DQ13) ; off-sheet GDDR6_M7_B_DQ13
GDDR6_M7_B_DQ14: U10000.BE27(GDDR_C7_B_DQ14) ; off-sheet GDDR6_M7_B_DQ14
GDDR6_M7_B_DQ15: U10000.BF27(GDDR_C7_B_DQ15) ; off-sheet GDDR6_M7_B_DQ15
GDDR6_M7_B_EDC0: U10000.BB18(GDDR_C7_B_EDC0) ; off-sheet GDDR6_M7_B_EDC0
GDDR6_M7_B_EDC1: U10000.BC28(GDDR_C7_B_EDC1) ; off-sheet GDDR6_M7_B_EDC1
GDDR6_M7_B_WCK0_DN: U10000.BG18(GDDR_C7_B_WCK0_DN) ; off-sheet GDDR6_M7_B_WCK0_DN
GDDR6_M7_B_WCK0_DP: U10000.BH18(GDDR_C7_B_WCK0_DP) ; off-sheet GDDR6_M7_B_WCK0_DP
GDDR6_M7_B_WCK1_DN: U10000.BH27(GDDR_C7_B_WCK1_DN) ; off-sheet GDDR6_M7_B_WCK1_DN
GDDR6_M7_B_WCK1_DP: U10000.BG27(GDDR_C7_B_WCK1_DP) ; off-sheet GDDR6_M7_B_WCK1_DP
GDDR6_M7_CK_DN: U10000.BJ22(GDDR_C7_CK_DN) ; off-sheet GDDR6_M7_CK_DN
GDDR6_M7_CK_DP: U10000.BK22(GDDR_C7_CK_DP) ; off-sheet GDDR6_M7_CK_DP
GDDR6_M7_RESET_N: U10000.BF18(GDDR_C7_RESET_N) ; off-sheet GDDR6_M7_RESET_N
GPU_G_RECOMP_G: R11125.1(A) U10000.BE1(GDDR_RCOMP_G)
GPU_G_RECOMP_H: R11126.1(A) U10000.BK19(GDDR_RCOMP_H)

## Notes on the sheet
- <XR_PAGE_TITLE>
- 8
- 7
- 6
- 5
- 4
- 3
- 2
- 1
- MODULE REV DETAILS
- GPU GDDR6 CHANNELS M6 M7
- MODULE NAME
- REV
- DATE
- D
- C
- B
- A
- BPAGE DRAWING
- INTEL
- DOCUMENT_NUMBER
- PAGE
- Wed May 11 04:02:59 2022
- h55_dg2_2dpc.GND
- CONFIDENTIAL
- 724452
- 221
- 0.9
- CUSTOM TEXT BPAGE
- (in symbol DG2_IP_NB_SKU1_SKU2_SKU3_EXT, part O) 15 OF 36
- (in symbol DG2_IP_NB_SKU1_SKU2_SKU3_EXT, part P) 16 OF 36

## Library data of the parts
R11125 = RES#1: CHIPS_PART_NAME: RES; CDS_PHYS_PART_NAME: RES_0201-C48657-042,CHIP,240,1%,0.05,LPDB,GENERIC; OriginalSymbolOrigin: (-75,25); XY: (0,5650); VER: 1; ROT: 0; PHYS_PAGE: 221; LOCATION: R11125; FP_TECH: LPDB; DRAWING: @RVP1_ADL_SB_ADP_S_DDR5_SODIMM_2DPC_LIB.H55_DG2_2DPC(SCH_1):PAGE392; CDS_LIB: discrete; PCB Footprint: SMR0201IA; CDS_PART_NAME: RES_0201-C48657-042,CHIP,240,1%,0.05,LPDB,GENERIC; CDS_LOCATION: R11125
R11126 = RES#1: CHIPS_PART_NAME: RES; CDS_PHYS_PART_NAME: RES_0201-C48657-042,CHIP,240,1%,0.05,LPDB,GENERIC; OriginalSymbolOrigin: (-75,25); XY: (4075,5725); VER: 1; ROT: 0; PHYS_PAGE: 221; LOCATION: R11126; FP_TECH: LPDB; DRAWING: @RVP1_ADL_SB_ADP_S_DDR5_SODIMM_2DPC_LIB.H55_DG2_2DPC(SCH_1):PAGE392; CDS_LIB: discrete; PCB Footprint: SMR0201IA; CDS_PART_NAME: RES_0201-C48657-042,CHIP,240,1%,0.05,LPDB,GENERIC; CDS_LOCATION: R11126
U10000 = DG2_IP_NB_SKU1_SKU2_SKU3_EXT: MANUF: INTEL CORP; CDS_PHYS_PART_NAME: DG2_IP_NB_SKU1_SKU2_SKU3_EXT_BGA-LPID7250,IC,DG2_IP_NB_SKU1_SKUA; CDS_LMAN_SYM_OUTLINE: -300,850,300,-800; OriginalSymbolOrigin: (-325,850); CaptureCellPackProp: DG2_IP_NB_SKU1_SKU2_SKU3_EXTO; XY: (-1775,7000); VER: 15; ROT: 0; PHYS_PAGE: 221; MFG_PN: NONE; LOCATION: U10000; DRAWING: @RVP1_ADL_SB_ADP_S_DDR5_SODIMM_2DPC_LIB.H55_DG2_2DPC(SCH_1):PAGE392; CDS_LIB: rvp1_adl_sb_adp_s_ddr5_sodimm_2dpc_lib; BMAP_REV: 1.0; PCB Footprint: CLPDB_BGA2660_DG2_SVC_512_LP7250_MA; SEC_TYPE: BGA; CHIPS_PART_NAME: DG2_IP_NB_SKU1_SKU2_SKU3_EXT; CDS_PART_NAME: DG2_IP_NB_SKU1_SKU2_SKU3_EXT_BGA-LPID7250,IC,DG2_IP_NB_SKU1_SKUA; CDS_LOCATION: U10000